# EasyEDA Pro project FPGA-G1.eprj, board logi Pi (continued)
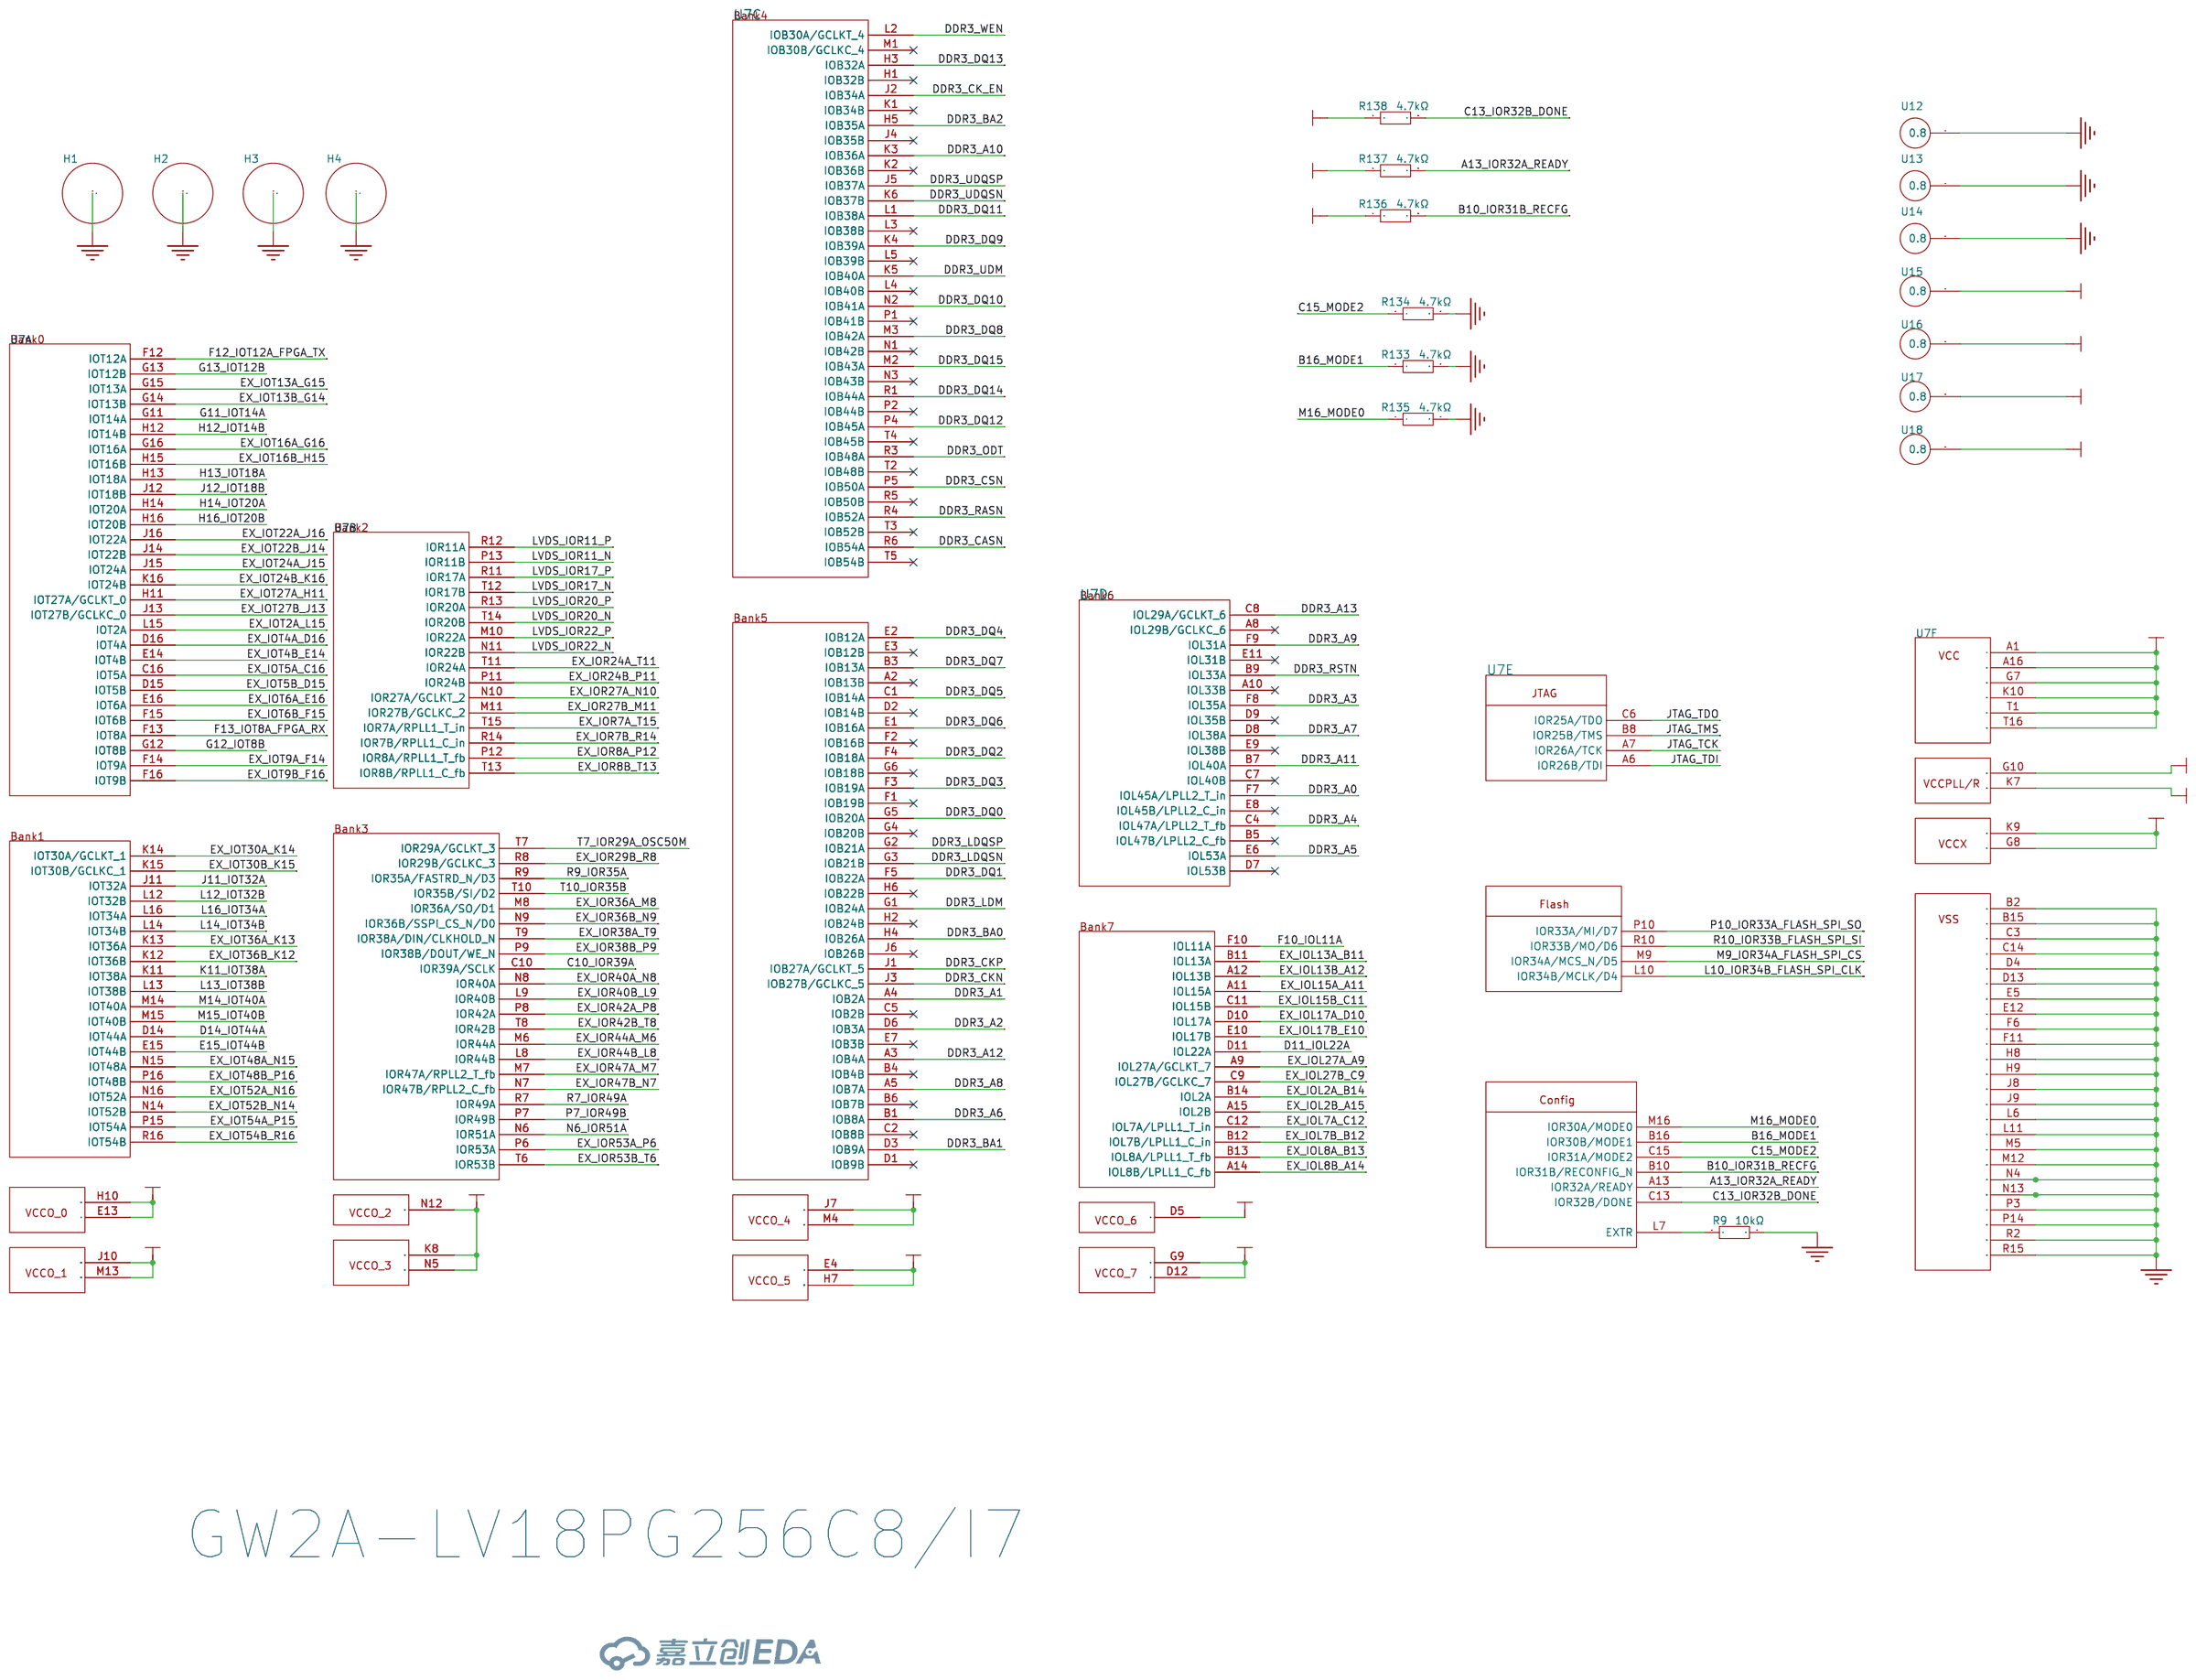
[diagram p0: FPGA]
## Routing (per net, layer and track width the routed paths; a pad name or vN(x,y) marks a point on that pad's centre or on a via; arc(x,y) is an arc through that point) (continued)
EX_IOR36A_M8: length 32.6
  Top Layer w0.109: U7.M8 v1(27.7,32.09)
  SIG03 w0.109: v1(27.7,32.09) 28.32,32.71 28.32,33.25 28.54,33.48 36.05,33.48 37.93,31.59 40.03,31.59 40.11,31.67 40.11,32.44 40.19,32.52 40.36,32.52 40.44,32.44 40.44,31.67 40.52,31.59 42.68,31.59 43.27,32.19 43.27,32.98 43.19,33.06 42.88,33.06 42.81,33.14 42.81,33.31 42.88,33.39 43.19,33.39 43.27,33.46 43.27,42.26 42.72,42.81 41.57,42.81
EX_IOR36B_N9: length 32.6
  Top Layer w0.109: U7.N9 v1(27.7,31.09)
  SIG03 w0.109: H6.14 43.61,43.31 43.61,32.04 42.85,31.28 37.57,31.28 36.14,32.71 29.48,32.71 29.11,32.34 29.11,31.85 28.94,31.69 28.3,31.69 v1(27.7,31.09)
EX_IOR38A_T9: length 32.6
  Top Layer w0.109: U7.T9 28.2,27.15 28.49,26.86 29.41,26.86 29.49,26.94 29.49,27.55 29.57,27.63 29.74,27.63 29.82,27.55 29.82,26.94 29.89,26.86 30.07,26.86 30.19,26.97 30.19,27.53 30.27,27.61 30.44,27.61 30.53,27.52 30.53,25.45 30.62,25.36 30.8,25.36 30.87,25.43 30.87,25.72 30.96,25.8 31.19,25.8 31.26,25.73 31.26,25.55 31.34,25.47 31.51,25.47 31.59,25.55 31.59,25.73 31.67,25.8 31.84,25.8 31.92,25.73 31.92,25.55 32,25.47 32.17,25.47 32.25,25.55 32.25,25.73 32.32,25.8 32.71,25.8 34.56,27.65 35.81,27.65 36.33,28.17 36.33,28.28 35.97,28.63 35.97,28.74 36.1,28.86 36.21,28.86 36.56,28.51 36.67,28.51 36.79,28.63 36.79,28.74 36.44,29.09 36.44,29.2 36.56,29.33 36.67,29.33 37.02,28.97 37.13,28.97 37.35,29.2 37.35,30.71 37.87,31.23 37.87,33.62 37.26,34.23 37.26,34.46 37.48,34.68 37.65,34.68 38.47,33.86 40.15,33.86 40.39,33.62 40.39,32.11 40.15,31.87 39.62,31.87 39.03,32.46 H6.23
EX_IOR38B_P9: length 32.6
  Top Layer w0.109: H6.24 41.57,32.57 40.6,31.59 38.64,31.59 37.61,30.57 37.61,29.06 35.78,27.22 34.69,27.22 32.94,25.47 32.94,24.02 32.7,23.79 32.57,23.79 32.49,23.86 32.49,25.03 32.41,25.11 32.24,25.11 32.16,25.03 32.16,23.86 32.09,23.79 31.91,23.79 31.84,23.86 31.84,25.03 31.76,25.11 31.59,25.11 31.51,25.03 31.51,23.86 31.43,23.79 31.26,23.79 31.18,23.86 31.18,25.03 31.1,25.11 30.93,25.11 30.85,25.03 30.85,23.86 30.78,23.79 30.47,23.79 30.29,23.96 30.29,25.64 29.38,26.55 28.32,26.55 27.85,27.02 27.85,30.28 28.16,30.59 28.2,30.59
EX_IOR40A_N8: length 32.6
  Top Layer w0.109: U7.N8 v1(26.7,32.09)
  SIG03 w0.109: v1(26.7,32.09) 26.7,32.25 28.43,33.97 37.17,33.97 37.25,33.9 37.25,33.39 37.33,33.32 37.5,33.32 37.58,33.39 37.58,33.9 37.66,33.97 40.07,33.97 40.15,34.05 40.15,36.15 40.23,36.23 40.4,36.23 40.48,36.15 40.48,34.05 40.55,33.97 42.14,33.97 42.64,34.48 42.64,39.1 42.53,39.21 42.33,39.21 42.22,39.1 42.22,38.86 42.14,38.79 41.97,38.79 41.89,38.86 41.89,39.11 41.81,39.19 41.64,39.19 41.56,39.11 41.56,38.86 41.48,38.79 41.31,38.79 41.23,38.86 41.23,39.11 41.16,39.19 40.92,39.19 40.83,39.09 40.83,38.47 H6.20
EX_IOR40B_L9: length 32.6
  Top Layer w0.109: U7.L9 v1(27.7,34.09)
  SIG03 w0.109: H6.11 38.68,47.89 38.16,48.41 38.16,49.07 38.41,49.31 40.18,49.31 40.45,49.04 40.45,46.83 40.53,46.75 41.24,46.75 41.32,46.67 41.32,46.5 41.24,46.42 40.53,46.42 40.45,46.35 40.45,36.8 39.96,36.31 37.93,36.31 36.63,35.02 34.55,35.02 34.02,34.48 28.09,34.48 v1(27.7,34.09)
EX_IOR42A_P8: length 32.6
  Top Layer w0.109: U7.P8 v1(26.7,30.09)
  SIG03 w0.109: H6.26 41.7,30.24 42.86,30.24 43.23,29.87 43.23,29.6 43.16,29.53 42.74,29.53 42.66,29.45 42.66,29.28 42.74,29.2 43.16,29.2 43.23,29.12 43.23,28.95 43.16,28.87 42.74,28.87 42.66,28.79 42.66,28.62 42.74,28.54 43.16,28.54 43.23,28.47 43.23,28.29 43.16,28.22 42.74,28.22 42.66,28.14 42.66,27.97 42.74,27.89 43.16,27.89 43.23,27.81 43.23,27.64 43.16,27.56 42.74,27.56 42.66,27.48 42.66,27.31 42.74,27.23 43.16,27.23 43.23,27.16 43.23,26.72 42.88,26.36 38.02,26.36 37.74,26.65 37.74,30.66 35.92,32.48 29.54,32.48 29.32,32.25 29.32,31.7 29.09,31.48 28.55,31.48 28.09,31.02 28.09,30.77 27.41,30.09 v1(26.7,30.09)
EX_IOR42B_T8: length 32.6
  Top Layer w0.109: H6.25 39.03,29.15 38.66,28.78 38.44,28.78 35.97,26.31 34.97,26.31 34.06,25.39 34.06,22.54 33.26,21.74 33.02,21.74 32.94,21.83 32.94,22.86 32.86,22.94 32.69,22.94 32.61,22.86 32.61,21.82 32.53,21.75 32.36,21.75 32.28,21.82 32.28,22.87 32.21,22.95 32.03,22.95 31.95,22.87 31.95,21.82 31.88,21.75 31.7,21.75 31.63,21.82 31.63,22.87 31.55,22.94 31.38,22.94 31.3,22.87 31.3,21.82 31.22,21.75 30.57,21.75 30.41,21.91 30.41,22.77 30.18,23 29.78,23 29.62,23.16 29.62,25.41 29.26,25.76 27.88,25.76 26.75,26.89 26.75,27.03 26.83,27.11 27.27,27.11 27.35,27.18 27.35,27.36 27.27,27.43 26.83,27.43 26.75,27.51 26.75,27.68 26.83,27.76 27.27,27.76 27.35,27.84 27.35,28.01 27.27,28.09 26.83,28.09 26.75,28.17 26.75,28.39 26.95,28.59 U7.T8
EX_IOR44A_M6: length 32.6
  Top Layer w0.109: U7.M6 v1(24.7,32.09)
  SIG03 w0.109: 39.03,42.81 37.97,41.75 37.97,38.88 37.43,38.33 37.43,37.68 35.93,36.18 32.39,36.18 32.08,36.49 29.59,36.49 29.33,36.75 29.33,38.32 28.95,38.7 28.95,39.23 28.87,39.3 28.7,39.3 28.62,39.23 28.62,38.66 28.54,38.58 28.37,38.58 28.29,38.66 28.29,39.23 28.22,39.3 28.04,39.3 27.96,39.23 27.96,38.57 27.89,38.49 27.75,38.49 27.66,38.59 27.66,39.2 27.56,39.3 27.39,39.3 27.31,39.23 27.31,38.78 27.23,38.71 26.44,38.71 26.37,38.63 26.37,38.3 26.29,38.22 26.12,38.22 26.04,38.3 26.04,38.63 25.96,38.71 25.26,38.71 25.1,38.55 25.1,32.49 v1(24.7,32.09)
EX_IOR44B_L8: length 32.6
  Top Layer w0.109: U7.L8 v1(26.7,33.09)
  SIG03 w0.109: v1(26.7,33.09) 27.09,33.48 27.09,34.23 27.55,34.69 33.87,34.69 34.43,35.25 36.42,35.25 37.73,36.56 39.77,36.56 40.14,36.93 40.14,38.77 40.06,38.84 39.84,38.84 39.76,38.92 39.76,39.09 39.84,39.17 40.06,39.17 40.14,39.25 40.14,41.33 40.06,41.41 39.07,41.41 39,41.49 39,41.66 39.07,41.74 40.06,41.74 40.14,41.82 40.14,46.54 39.92,46.77 38.31,46.77 38.13,46.59 38.13,45.64 38.42,45.35 H6.13
EX_IOR47A_M7: length 32.6
  Top Layer w0.109: U7.M7 v1(25.7,32.09)
  SIG03 w0.109: H6.17 39.03,39.6 37.73,38.3 37.73,37.53 36.08,35.88 32.46,35.88 32.3,35.72 29.22,35.72 29.11,35.83 29.11,36.28 29.03,36.36 27.99,36.36 27.91,36.44 27.91,36.61 27.99,36.69 29.03,36.69 29.11,36.77 29.11,37.36 28.98,37.49 27.25,37.49 27.15,37.39 27.15,36.74 27.07,36.66 26.47,36.66 26.39,36.59 26.39,36.41 26.47,36.34 27.07,36.34 27.15,36.26 27.15,36 27.04,35.89 26.24,35.89 26.15,35.98 26.15,37.37 26.03,37.49 25.43,37.49 25.31,37.38 25.31,36.7 25.39,36.62 25.78,36.62 25.86,36.55 25.86,36.37 25.78,36.3 25.39,36.3 25.31,36.22 25.31,36.05 25.39,35.97 25.78,35.97 25.86,35.89 25.86,35.72 25.78,35.64 25.39,35.64 25.31,35.56 25.31,32.48 v1(25.7,32.09)
EX_IOR47B_N7: length 32.6
  Top Layer w0.109: U7.N7 v1(25.7,31.09)
  SIG03 w0.109: 39.03,37.33 H6.19 38.4,37.73 36.17,35.51 26.57,35.51 26.09,35.02 26.09,31.93 25.86,31.71 24.45,31.71 24.37,31.63 24.37,31.31 24.3,31.23 24.12,31.23 24.05,31.31 24.05,31.63 23.97,31.71 23.47,31.71 23.39,31.63 23.39,31.32 23.31,31.25 23.14,31.25 23.06,31.32 23.06,31.63 22.98,31.71 22.46,31.71 22.38,31.63 22.38,31.32 22.31,31.24 22.13,31.24 22.06,31.32 22.06,31.63 21.98,31.71 21.66,31.71 21.6,31.64 21.6,31.36 21.52,31.29 21,31.29 20.85,31.13 20.85,30.86 21.02,30.69 21.94,30.69 22.03,30.78 22.03,30.89 22.11,30.97 22.28,30.97 22.36,30.89 22.36,30.78 22.44,30.7 22.97,30.7 23.04,30.78 23.04,30.88 23.12,30.96 23.29,30.96 23.37,30.88 23.37,30.78 23.45,30.7 23.96,30.7 24.04,30.78 24.04,30.88 24.11,30.96 24.29,30.96 24.36,30.88 24.36,30.78 24.44,30.7 25.31,30.7 v1(25.7,31.09)
EX_IOR53A_P6: length 32.6
  Top Layer w0.109: U7.P6 v1(24.7,30.09)
  SIG03 w0.109: v1(24.7,30.09) 24.7,30.09 24.7,29.79 24.61,29.71 23.28,29.71 23.22,29.77 23.22,30.25 22.99,30.48 22.25,30.48 22.09,30.31 22.09,29.81 22.16,29.73 22.29,29.73 22.37,29.65 22.37,29.48 22.29,29.4 22.16,29.4 22.09,29.32 22.09,27.99 22.15,27.93 22.33,27.93 22.41,28.01 22.41,28.42 22.52,28.53 22.84,28.53 22.92,28.45 22.92,28.04 22.99,27.96 23.17,27.96 23.24,28.04 23.24,28.45 23.32,28.53 23.5,28.53 23.57,28.45 23.57,28.04 23.65,27.96 23.82,27.96 23.9,28.04 23.9,28.45 23.98,28.53 24.46,28.53 24.54,28.6 24.54,29.36 24.62,29.43 24.79,29.43 24.87,29.36 24.87,28.6 24.94,28.53 25.18,28.53 25.28,28.63 25.28,30.26 25.59,30.56 25.83,30.56 26.3,31.03 26.3,32.23 26.57,32.5 26.66,32.5 28.39,34.23 38.38,34.23 39.03,34.88 H6.21
EX_IOR53B_T6: length 32.6
  Top Layer w0.109: U7.T6 v1(24.7,28.09)
  SIG03 w0.109: H6.18 42.16,40.87 42.57,40.87 42.93,40.51 42.93,34.17 42.48,33.72 38.58,33.72 37.94,33.08 37.94,32.42 37.83,32.32 37.64,32.32 36.24,33.72 28.49,33.72 27.09,32.33 27.09,31.73 26.65,31.28 26.65,31.02 26.09,30.46 26.09,28.79 25.35,28.05 24.74,28.05 v1(24.7,28.09)
EX_IOT2A_L15: length 29.7
  Top Layer w0.203: U7.L15 34.7,33.09 36.28,33.09 36.46,33.28 37.33,33.28 37.54,33.07 37.54,31.29 37.05,30.8 37.05,30.51 v1(36.92,30.38)
  Top Layer w0.254: 32.98,10.36 32.98,10.95 32.99,10.96
  SIG03 w0.203: v1(32.99,11.07) 33.77,11.84 35.83,11.84 37.22,13.23 37.22,30.09 v1(36.92,30.38)
EX_IOT4A_D16: length 62.8
  Top Layer w0.104: v1(35.57,40.59) 35.56,40.59 U7.D16
  SIG03 w0.104: H5.13 4.52,45.35 4.6,45.42 4.6,46.24 5.16,46.8 6.65,46.8 8.76,48.91 8.76,50.75 13.92,55.9 14.27,55.9 14.63,55.54 14.63,53.82 14.7,53.75 14.88,53.75 14.96,53.82 14.96,55.65 15.21,55.9 15.64,55.9 15.9,55.65 15.9,54.62 15.97,54.54 16.15,54.54 16.22,54.62 16.22,55.65 16.47,55.9 16.91,55.9 17.16,55.65 17.16,53.82 17.23,53.75 17.41,53.75 17.49,53.82 17.49,55.42 17.97,55.9 19.56,55.9 19.85,55.61 19.85,55.25 19.93,55.17 20.11,55.17 20.18,55.25 20.18,55.61 20.43,55.86 20.87,55.86 21.12,55.61 21.12,55.25 21.19,55.17 21.37,55.17 21.44,55.25 21.44,55.61 21.7,55.86 23.89,55.86 24.45,56.42 26.97,56.42 28.38,55.01 29.18,55.01 29.93,54.26 30.81,54.26 31.06,54.01 31.06,51.92 34.47,48.52 34.47,40.95 34.82,40.59 35.56,40.59 v1(35.57,40.59)
EX_IOT4B_E14: length 62.8
  Top Layer w0.104: U7.E14 v1(33.7,40.09)
  SIG03 w0.104: H5.14 4.97,45.35 4.9,45.42 4.9,46.12 5.28,46.5 6.78,46.5 9.07,48.79 9.07,50.62 13.97,55.52 14.18,55.52 14.33,55.37 14.33,53.7 14.58,53.45 15.01,53.45 15.26,53.7 15.26,55.52 15.34,55.59 15.52,55.59 15.59,55.52 15.59,54.49 15.84,54.24 16.28,54.24 16.53,54.49 16.53,55.52 16.6,55.59 16.78,55.59 16.85,55.52 16.85,53.7 17.11,53.45 17.54,53.45 17.79,53.7 17.79,55.21 18.14,55.56 19.47,55.56 19.55,55.48 19.55,55.12 19.8,54.87 20.23,54.87 20.49,55.12 20.49,55.48 20.56,55.56 20.74,55.56 20.81,55.48 20.81,55.12 21.06,54.87 21.5,54.87 21.75,55.12 21.75,55.48 21.82,55.56 24.22,55.56 24.69,56.03 25.59,56.03 25.67,55.96 25.67,55.74 25.74,55.67 25.92,55.67 25.99,55.74 25.99,55.96 26.07,56.03 26.25,56.03 26.32,55.96 26.32,55.74 26.39,55.67 26.58,55.67 26.65,55.74 26.65,55.96 26.72,56.03 26.93,56.03 28.25,54.7 29.06,54.7 29.8,53.96 30.68,53.96 30.76,53.88 30.76,51.64 34.11,48.28 34.11,40.47 33.74,40.09 v1(33.7,40.09)
EX_IOT5A_C16: length 62.8
  Top Layer w0.104: 35.2,41.6 35.57,41.97 v1(35.57,42.07)
  SIG03 w0.104: H5.11 4.52,47.89 4.6,47.96 4.6,48.74 5.17,49.32 7.03,49.32 7.8,50.09 7.8,51.6 8.1,51.9 8.46,51.9 8.68,51.69 8.78,51.69 8.91,51.81 8.91,51.92 8.69,52.13 8.69,52.49 9,52.8 9.35,52.8 9.57,52.58 9.67,52.58 9.8,52.71 9.8,52.81 9.58,53.03 9.58,53.39 9.89,53.69 10.25,53.69 10.46,53.47 10.57,53.47 10.7,53.6 10.7,53.71 10.48,53.92 10.48,54.28 10.78,54.59 11.14,54.59 11.36,54.37 11.46,54.37 11.59,54.5 11.59,54.6 11.37,54.82 11.37,55.17 11.68,55.48 12.04,55.48 12.25,55.26 12.36,55.26 12.49,55.39 12.49,55.49 12.27,55.71 12.27,56.07 13.24,57.04 14.44,57.04 14.69,56.79 14.69,56.58 14.76,56.51 14.94,56.51 15.02,56.58 15.02,56.79 15.27,57.04 15.7,57.04 15.95,56.79 15.95,56.58 16.03,56.51 16.21,56.51 16.28,56.58 16.28,56.79 16.53,57.04 16.97,57.04 17.22,56.79 17.22,56.58 17.29,56.51 17.47,56.51 17.55,56.58 17.55,56.79 17.8,57.04 19.54,57.04 19.79,56.79 19.79,56.56 19.87,56.49 20.05,56.49 20.12,56.56 20.12,56.79 20.37,57.04 20.8,57.04 21.06,56.79 21.06,56.56 21.13,56.49 21.31,56.49 21.38,56.56 21.38,56.79 21.64,57.04 27.59,57.04 27.85,56.79 27.85,56.26 27.92,56.19 28.1,56.19 28.17,56.26 28.17,56.79 28.43,57.04 28.86,57.04 29.11,56.79 29.11,56.25 29.18,56.18 29.36,56.18 29.44,56.25 29.44,56.79 29.69,57.04 30.33,57.04 31.09,56.28 31.09,55.14 32.26,53.97 32.26,51.74 35.14,48.85 35.14,48.54 35.22,48.47 35.68,48.47 35.93,48.22 35.93,47.78 35.68,47.53 35.22,47.53 35.14,47.46 35.14,46.31 35.23,46.23 35.47,46.23 35.55,46.16 35.55,45.97 35.47,45.9 35.23,45.9 35.15,45.83 35.15,45.65 35.23,45.57 35.47,45.57 35.55,45.5 35.55,45.32 35.47,45.25 35.23,45.25 35.15,45.17 35.15,42.45 35.53,42.07 v1(35.57,42.07)
EX_IOT5B_D15: length 62.8
  Top Layer w0.104: v1(35.57,41.15) 34.76,41.15 U7.D15
  SIG03 w0.104: v1(35.57,41.15) 35.15,41.15 34.84,41.46 34.84,47.58 35.09,47.84 35.55,47.84 35.62,47.91 35.62,48.09 35.55,48.16 35.09,48.16 34.84,48.42 34.84,48.73 31.95,51.61 31.95,53.79 30.75,54.99 30.75,55.37 ; 30.75,55.37 30.75,56.2 30.21,56.74 29.82,56.74 29.74,56.66 29.74,56.13 29.49,55.87 29.06,55.87 28.81,56.13 28.81,56.66 28.73,56.74 28.55,56.74 28.48,56.66 28.48,56.14 28.23,55.89 27.79,55.89 27.54,56.14 27.54,56.66 27.47,56.74 21.76,56.74 21.69,56.66 21.69,56.44 21.44,56.19 21,56.19 20.75,56.44 20.75,56.66 20.68,56.74 20.5,56.74 20.42,56.66 20.42,56.44 20.17,56.19 19.74,56.19 19.49,56.44 19.49,56.66 19.41,56.74 17.92,56.74 17.85,56.66 17.85,56.45 17.6,56.2 17.17,56.2 16.91,56.45 16.91,56.66 16.84,56.74 16.66,56.74 16.59,56.66 16.59,56.45 16.33,56.2 15.9,56.2 15.65,56.45 15.65,56.66 15.57,56.74 15.39,56.74 15.32,56.66 15.32,56.45 15.07,56.2 14.64,56.2 14.38,56.45 14.38,56.66 14.31,56.74 13.37,56.74 12.57,55.94 12.57,55.84 12.79,55.62 12.79,55.26 12.48,54.96 12.13,54.96 11.91,55.18 11.81,55.18 11.68,55.05 11.68,54.94 11.9,54.73 11.9,54.37 11.59,54.06 11.23,54.06 11.01,54.28 10.91,54.28 10.78,54.15 10.78,54.05 11,53.83 11,53.48 10.69,53.17 10.34,53.17 10.12,53.39 10.02,53.39 9.89,53.26 9.89,53.16 10.11,52.94 10.11,52.58 9.8,52.27 9.44,52.27 9.23,52.49 9.12,52.49 8.99,52.37 8.99,52.26 9.21,52.04 9.21,51.69 8.91,51.38 8.55,51.38 8.33,51.6 8.23,51.6 8.11,51.48 8.11,49.96 7.16,49.01 5.3,49.01 4.9,48.62 4.9,47.96 4.97,47.89 H5.12 ; 30.75,55.37 30.75,55.37
EX_IOT6A_E16: length 62.8
  Top Layer w0.104: U7.E16 35.35,39.59 35.97,40.22 35.97,40.77 v1(36.36,41.16)
  SIG03 w0.104: H5.9 4.52,50.43 4.6,50.5 4.6,51.36 5.15,51.91 6.91,51.91 7.92,52.92 7.92,53.03 7.43,53.52 7.43,53.88 7.74,54.19 8.09,54.19 8.59,53.69 8.69,53.69 8.82,53.82 8.82,53.92 8.32,54.42 8.32,54.78 8.63,55.08 8.99,55.08 9.48,54.59 9.59,54.59 9.71,54.71 9.71,54.82 9.22,55.31 9.22,55.67 9.52,55.98 9.88,55.98 10.38,55.48 10.48,55.48 10.61,55.61 10.61,55.71 10.11,56.21 10.11,56.56 10.42,56.87 10.78,56.87 11.27,56.38 11.37,56.38 11.5,56.5 11.5,56.61 11.01,57.1 11.01,57.46 11.31,57.76 11.67,57.76 12.16,57.27 12.27,57.27 12.69,57.69 31.35,57.69 31.65,57.39 31.65,56.84 31.73,56.77 32.07,56.77 32.32,56.51 32.32,56.08 32.07,55.83 31.73,55.83 31.65,55.76 31.65,55.59 32.9,54.34 32.9,53.13 33.11,52.93 33.21,52.93 33.48,53.2 33.59,53.2 33.72,53.07 33.72,52.97 33.44,52.7 33.44,52.5 34.36,51.57 34.56,51.57 34.71,51.71 34.81,51.71 34.94,51.58 34.94,51.48 34.8,51.34 34.8,51.07 36.46,49.4 36.46,41.26
EX_IOT6B_F15: length 62.8
  Top Layer w0.104: v1(36.36,40.59) 36.36,39.56 36.09,39.28 35.4,39.28 35.2,39.08 34.69,39.08 U7.F15
  SIG03 w0.104: v1(36.36,40.59) 36.25,40.59 35.96,40.88 35.96,42.11 36.15,42.3 36.15,49.28 32.59,52.85 32.59,54.1 31.35,55.34 31.35,55.75 31.35,55.88 31.6,56.13 31.94,56.13 32.01,56.21 32.01,56.39 31.94,56.46 31.6,56.46 31.35,56.71 31.35,57.26 31.22,57.39 12.81,57.39 12.39,56.96 12.04,56.96 11.54,57.46 11.44,57.46 11.31,57.33 11.31,57.23 11.81,56.73 11.81,56.38 11.5,56.07 11.14,56.07 10.65,56.57 10.54,56.57 10.42,56.44 10.42,56.33 10.91,55.84 10.91,55.48 10.61,55.18 10.25,55.18 9.75,55.67 9.65,55.67 9.52,55.54 9.52,55.44 10.02,54.94 10.02,54.59 9.71,54.28 9.35,54.28 8.86,54.78 8.76,54.78 8.63,54.65 8.63,54.54 9.12,54.05 9.12,53.69 8.82,53.39 8.46,53.39 7.97,53.88 7.86,53.88 7.73,53.75 7.73,53.65 8.23,53.16 8.23,52.8 7.04,51.61 5.28,51.61 4.9,51.23 4.9,50.5 4.97,50.43 H5.10
EX_IOT9A_F14: length 62.8
  Top Layer w0.104: U7.F14 v1(33.7,39.09)
  SIG03 w0.104: H5.5 4.52,55.51 4.6,55.58 4.6,56.23 5.34,56.98 8.08,56.98 10.76,59.66 18.24,59.66 18.49,59.41 18.49,59.07 18.57,59 18.75,59 18.82,59.07 18.82,59.41 19.07,59.66 19.51,59.66 19.76,59.41 19.76,59.07 19.83,59 20.01,59 20.09,59.07 20.09,59.41 20.34,59.66 23.94,59.66 24.31,59.29 27.72,59.29 29.04,60.62 32.19,60.62 34.52,58.29 34.52,54.59 36.53,52.57 36.87,52.57 37.76,51.68 37.76,39.15 36.98,38.37 35.4,38.37 35.1,38.68 34.12,38.68 v1(33.7,39.09)
EX_IOT9B_F16: length 62.8
  Top Layer w0.104: U7.F16 35.44,38.59 v1(35.7,38.85)
  SIG03 w0.104: 35.7,38.85 36.92,38.85 37.42,39.35 37.42,51.59 36.79,52.22 36.46,52.22 34.22,54.46 34.22,58.17 32.07,60.32 29.17,60.32 27.84,58.99 24.18,58.99 23.81,59.36 20.47,59.36 20.39,59.28 20.39,58.94 20.14,58.69 19.71,58.69 19.45,58.94 19.45,59.28 19.38,59.36 19.2,59.36 19.13,59.28 19.13,58.94 18.87,58.69 18.44,58.69 18.19,58.94 18.19,59.28 18.12,59.36 14.27,59.36 14.19,59.28 14.19,58.83 14.12,58.76 13.94,58.76 13.87,58.83 13.87,59.28 13.79,59.36 13.61,59.36 13.54,59.28 13.54,58.83 13.47,58.76 13.29,58.76 13.21,58.83 13.21,59.28 13.14,59.36 12.96,59.36 12.88,59.28 12.88,58.83 12.81,58.76 12.63,58.76 12.56,58.83 12.56,59.28 12.48,59.36 12.3,59.36 12.23,59.28 12.23,58.83 12.16,58.76 11.98,58.76 11.9,58.83 11.9,59.28 11.83,59.36 10.89,59.36 8.21,56.68 5.47,56.68 4.9,56.11 4.9,55.58 4.97,55.51 H5.6
EX_IOT13A_G15: length 62.8
  Top Layer w0.104: U7.G15 v1(34.7,38.09)
  Bottom Layer w0.104: H6.7 40.07,52.97 40.15,52.9 40.15,52.46 39.57,51.89 37.58,51.89 36.81,52.66 36.81,54.29 32.93,58.16 29.66,58.16 29.59,58.24 29.59,58.52 29.51,58.6 29.33,58.6 29.26,58.52 29.26,58.24 29.18,58.16 29,58.16 28.93,58.24 28.93,58.52 28.86,58.6 28.68,58.6 28.6,58.52 28.6,58.24 28.53,58.16 28.35,58.16 28.27,58.24 28.27,58.52 28.2,58.6 28.02,58.6 27.95,58.52 27.95,58.24 27.87,58.16 27.69,58.16 27.62,58.24 27.62,58.52 27.55,58.6 27.37,58.6 27.29,58.52 27.29,58.24 27.22,58.16 27.09,58.16 26.84,57.91 26.84,55.52 26.76,55.45 26.58,55.45 26.51,55.52 26.51,57.91 26.26,58.16 25.7,58.16 25.46,57.92 25.46,53.75 26.06,53.15 26.06,51.51 26.36,51.21 26.94,51.21 27.19,51.47 27.19,53.36 27.26,53.43 27.44,53.43 27.52,53.36 27.52,51.47 27.77,51.21 31.12,51.21 32.06,50.28 32.06,49.11 32.9,48.26 33.69,48.26 34.5,47.45 35.91,47.45 36.79,46.58 36.79,39.17 36.05,38.43 35.05,38.43 v1(34.7,38.09)
EX_IOT13B_G14: length 62.8
  Top Layer w0.104: U7.G14 v1(33.7,38.09)
  Bottom Layer w0.104: H6.8 40.52,52.97 40.45,52.9 40.45,52.34 39.7,51.58 37.45,51.58 36.5,52.53 36.5,54.16 32.81,57.86 27.21,57.86 27.14,57.79 27.14,55.26 27.02,55.14 26.94,55.14 26.87,55.07 26.87,54.88 26.79,54.8 26.61,54.8 26.54,54.88 26.54,55.07 26.46,55.14 26.32,55.14 26.2,55.26 26.2,57.79 26.13,57.86 25.9,57.86 25.77,57.72 25.77,53.88 26.37,53.27 26.37,51.63 26.48,51.52 26.81,51.52 26.88,51.59 26.88,53.48 27.14,53.73 27.57,53.73 27.82,53.48 27.82,51.59 27.9,51.52 31.25,51.52 32.36,50.41 32.36,49.23 33.03,48.57 33.82,48.57 34.63,47.76 36.04,47.76 37.11,46.69 37.11,38.65 36.54,38.08 35.52,38.08 35.09,37.65 34.29,37.65 33.85,38.09 v1(33.7,38.09) 33.7,38.25
EX_IOT16A_G16: length 62.8
  Top Layer w0.104: 35.59,37.62 35.56,37.59 U7.G16
  Bottom Layer w0.104: H6.9 40.07,50.43 40.15,50.36 40.15,49.59 39.87,49.31 37.78,49.31 37.42,49.68 37.42,50.33 36.15,51.6 36.15,53.06 35.61,53.6 35.61,54.32 33.59,56.34 32.87,56.34 32.33,56.88 32.33,57.11 31.81,57.64 30.65,57.64 30.4,57.39 30.4,56.28 30.65,56.02 31.08,56.02 31.16,55.95 31.16,55.77 31.08,55.7 30.65,55.7 30.4,55.44 30.4,55.01 30.65,54.76 31.08,54.76 31.16,54.69 31.16,54.5 31.08,54.43 30.65,54.43 30.4,54.18 30.4,52.97 30.33,52.89 30.15,52.89 30.07,52.97 30.07,57.39 29.82,57.64 28.2,57.64 27.87,57.3 27.87,57.15 27.79,57.07 27.68,57.07 27.61,57 27.61,56.82 27.68,56.75 27.79,56.75 27.87,56.67 27.87,56.49 27.79,56.42 27.68,56.42 27.61,56.34 27.61,56.16 27.68,56.09 27.79,56.09 27.87,56.02 27.87,55.84 27.79,55.76 27.68,55.76 27.61,55.69 27.61,55.51 27.68,55.43 27.79,55.43 27.87,55.36 27.87,54.59 28.21,54.24 28.21,53.27 28.37,53.12 28.37,53.02 28.26,52.91 28.26,52.8 28.39,52.67 28.49,52.67 28.6,52.78 28.7,52.78 28.83,52.66 28.83,52.55 28.72,52.44 28.72,52.34 28.85,52.21 28.95,52.21 29.06,52.32 29.17,52.32 29.62,51.86 31.42,51.86 31.67,51.61 32.03,51.61 32.62,52.21 32.73,52.21 32.85,52.08 32.85,51.97 32.26,51.38 32.26,51.02 32.68,50.61 32.68,49.51 33.19,48.99 33.96,48.99 34.8,48.15 36.29,48.15 37.54,46.91 37.54,38.47 36.72,37.65 35.62,37.65 35.59,37.62
  vias: v1(35.7,37.62)
EX_IOT16B_H15: length 62.8
  Top Layer w0.104: U7.H15 v1(34.7,37.09)
  Bottom Layer w0.104: H6.10 40.52,50.43 40.45,50.36 40.45,49.46 40,49.01 37.66,49.01 37.12,49.55 37.12,50.2 35.84,51.48 35.84,52.94 35.31,53.48 35.31,54.2 33.47,56.04 32.74,56.04 32.03,56.76 32.03,56.99 31.68,57.33 30.78,57.33 30.71,57.26 30.71,56.4 30.78,56.33 31.21,56.33 31.46,56.08 31.46,55.64 31.21,55.39 30.78,55.39 30.71,55.32 30.71,55.14 30.78,55.06 31.21,55.06 31.46,54.81 31.46,54.38 31.21,54.13 30.78,54.13 30.71,54.05 30.71,52.84 30.45,52.59 30.02,52.59 29.77,52.84 29.77,57.26 29.69,57.33 28.62,57.33 28.17,56.88 28.17,54.72 28.92,53.96 28.92,53 29.75,52.17 31.55,52.17 31.8,51.92 31.91,51.92 32.5,52.51 32.85,52.51 33.16,52.2 33.16,51.85 32.57,51.26 32.57,51.15 32.98,50.74 32.98,49.63 33.32,49.29 34.09,49.29 34.93,48.45 36.42,48.45 37.87,47 37.87,38.13 36.73,36.99 34.81,36.99 v1(34.7,37.09)
EX_IOT22A_J16: length 62.8
  Top Layer w0.104: U7.J16 35.45,35.84 36.06,35.84 37.39,37.18 37.39,52.79 v1(37.29,52.89)
  SIG03 w0.104: H5.4 4.97,58.05 4.9,58.12 4.9,58.78 5.25,59.13 7.52,59.13 7.59,59.06 7.59,58.75 7.67,58.67 7.85,58.67 7.92,58.75 7.92,59.06 7.99,59.13 8.17,59.13 8.25,59.06 8.25,58.75 8.32,58.67 8.5,58.67 8.58,58.75 8.58,59.06 8.65,59.13 8.83,59.13 8.9,59.06 8.9,58.75 8.98,58.67 9.16,58.67 9.23,58.75 9.23,59.06 9.3,59.13 9.54,59.13 10.94,60.53 11.27,60.53 11.34,60.46 11.34,60.15 11.42,60.07 11.6,60.07 11.67,60.15 11.67,60.46 11.75,60.53 11.93,60.53 12,60.46 12,60.15 12.07,60.07 12.25,60.07 12.33,60.15 12.33,60.46 12.4,60.53 28.37,60.53 28.81,60.97 32.69,60.97 34.94,58.72 34.94,55.7 36.5,54.14 36.5,53.71 36.91,53.3 36.91,53.29 37.29,52.91 v1(37.29,52.89)
EX_IOT22B_J14: length 62.8
  Top Layer w0.104: U7.J14 33.76,36.15 35.93,36.15 37.07,37.29 37.07,52.29 36.75,52.61 36.75,53.11 37.09,53.45 v1(37.29,53.45)
  SIG03 w0.104: H5.3 4.52,58.05 4.6,58.12 4.6,58.9 5.13,59.43 7.5,59.43 7.58,59.51 7.58,59.82 7.65,59.9 7.83,59.9 7.9,59.82 7.9,59.51 7.98,59.43 9.21,59.43 10.65,60.88 28.29,60.88 28.68,61.27 32.87,61.27 35.33,58.81 35.33,55.76 36.81,54.28 36.81,53.92 v1(37.29,53.45)
EX_IOT24A_J15: length 62.8
  Top Layer w0.104: U7.J15 34.75,35.04 36.31,35.04 37.67,36.4 37.67,54.46 v1(37.38,54.75)
  SIG03 w0.104: v1(37.38,54.75) 37.4,54.78 37.4,58.57 34.91,61.06 33.47,61.06 32.82,61.71 7.87,61.71 7.79,61.64 7.79,61.47 7.72,61.4 7.54,61.4 7.47,61.47 7.47,61.64 7.39,61.71 5.23,61.71 4.9,61.38 4.9,60.7 5.02,60.59 H5.2
EX_IOT24B_K16: length 62.8
  Top Layer w0.104: v1(37.93,54.74) 37.97,54.7 37.97,36.18 36.39,34.59 U7.K16
  SIG03 w0.104: v1(37.93,54.74) 37.71,54.97 37.71,58.69 35.04,61.36 33.6,61.36 32.94,62.02 5,62.02 4.6,61.61 4.6,60.66 4.52,60.59 H5.1
EX_IOT27A_H11: length 62.8
  Top Layer w0.104: U7.H11 29.7,37.09
  SIG03 w0.104: H5.8 4.97,52.97 4.9,53.04 4.9,53.72 5.3,54.11 7.25,54.11 11.12,57.99 28.91,57.99 29.16,58.24 29.16,59.04 29.24,59.11 29.42,59.11 29.49,59.04 29.49,58.24 29.75,57.99 32.38,57.99 33.25,57.11 33.25,53.92 36.8,50.37 36.8,39.92 36.58,39.71 36.17,39.71 36,39.89 35.82,39.89 35.64,39.71 33.41,39.71 33.08,39.38 33.08,37.89 32.9,37.71 30.32,37.71 29.7,37.09
  vias: v1(29.72,37.09)
EX_IOT27B_J13: length 62.8
  Top Layer w0.104: U7.J13 32.7,36.09 32.7,37.07 32.68,37.09
  SIG03 w0.104: 32.68,37.09 33.32,37.73 33.32,39.25 33.56,39.49 34.02,39.49 34.28,39.23 36.65,39.23 37.1,39.69 37.1,50.56 33.56,54.1 33.56,57.92 33.18,58.29 29.87,58.29 29.8,58.36 29.8,59.16 29.55,59.42 29.11,59.42 28.86,59.16 28.86,58.36 28.79,58.29 10.99,58.29 7.12,54.42 5.17,54.42 4.6,53.84 4.6,53.04 4.52,52.97 H5.7
  vias: v1(32.7,37.09)
EX_IOT30A_K14: length 22.1
  Top Layer w0.104: U7.K14 v1(32.7,35.09)
  SIG04 w0.104: v1(32.7,35.09) 33.1,34.7 37.2,34.7 38.16,33.74 42.95,33.74 43.39,33.3 43.39,32.1 43.14,31.85 43.04,31.85 42.88,31.69 42.88,31.15 43.02,31.01 43.09,31.01 43.38,30.72 43.39,30.72 43.39,29.48 42.9,28.99 40.71,28.99 40.15,28.43 40.15,27.64 40.07,27.57 H6.27
EX_IOT30B_K15: length 22.1
  Top Layer w0.104: U7.K15 v1(33.7,35.09)
  SIG04 w0.104: H6.28 40.52,27.57 40.45,27.64 40.45,28.3 40.84,28.69 43.3,28.69 43.81,29.2 43.81,30.91 43.6,31.12 43.41,31.12 43.27,31.27 43.27,31.55 43.46,31.74 43.64,31.74 43.81,31.91 43.81,33.66 43.4,34.07 38.26,34.07 37.24,35.09 v1(33.7,35.09)
EX_IOT36A_K13: length 22.1
  Top Layer w0.104: v1(30.7,35.09) 30.7,34.39 30.96,34.13 31.74,34.13 U7.K13
  SIG04 w0.104: v1(30.7,35.09) 31.03,34.76 31.03,34.52 32.09,33.47 32.08,32.81 32.41,32.48 34.18,32.48 35.15,33.45 36.31,33.45 37.6,32.17 37.6,26.62 38.15,26.07 39.88,26.07 40.06,25.88 40.06,25.1 39.99,25.03 39.03,25.03
EX_IOT36B_K12: length 22.1
  Top Layer w0.104: U7.K12 31.23,34.59 v1(31.71,35.08)
  SIG04 w0.102: 35.29,33.98 34,32.69 32.5,32.69 ; 31.36,34.74 31.36,34.49 32.29,33.56 32.29,33.24